# EasyEDA Pro project YanQi_Project_V2.0.eprj, board PayloadBoard (continued)
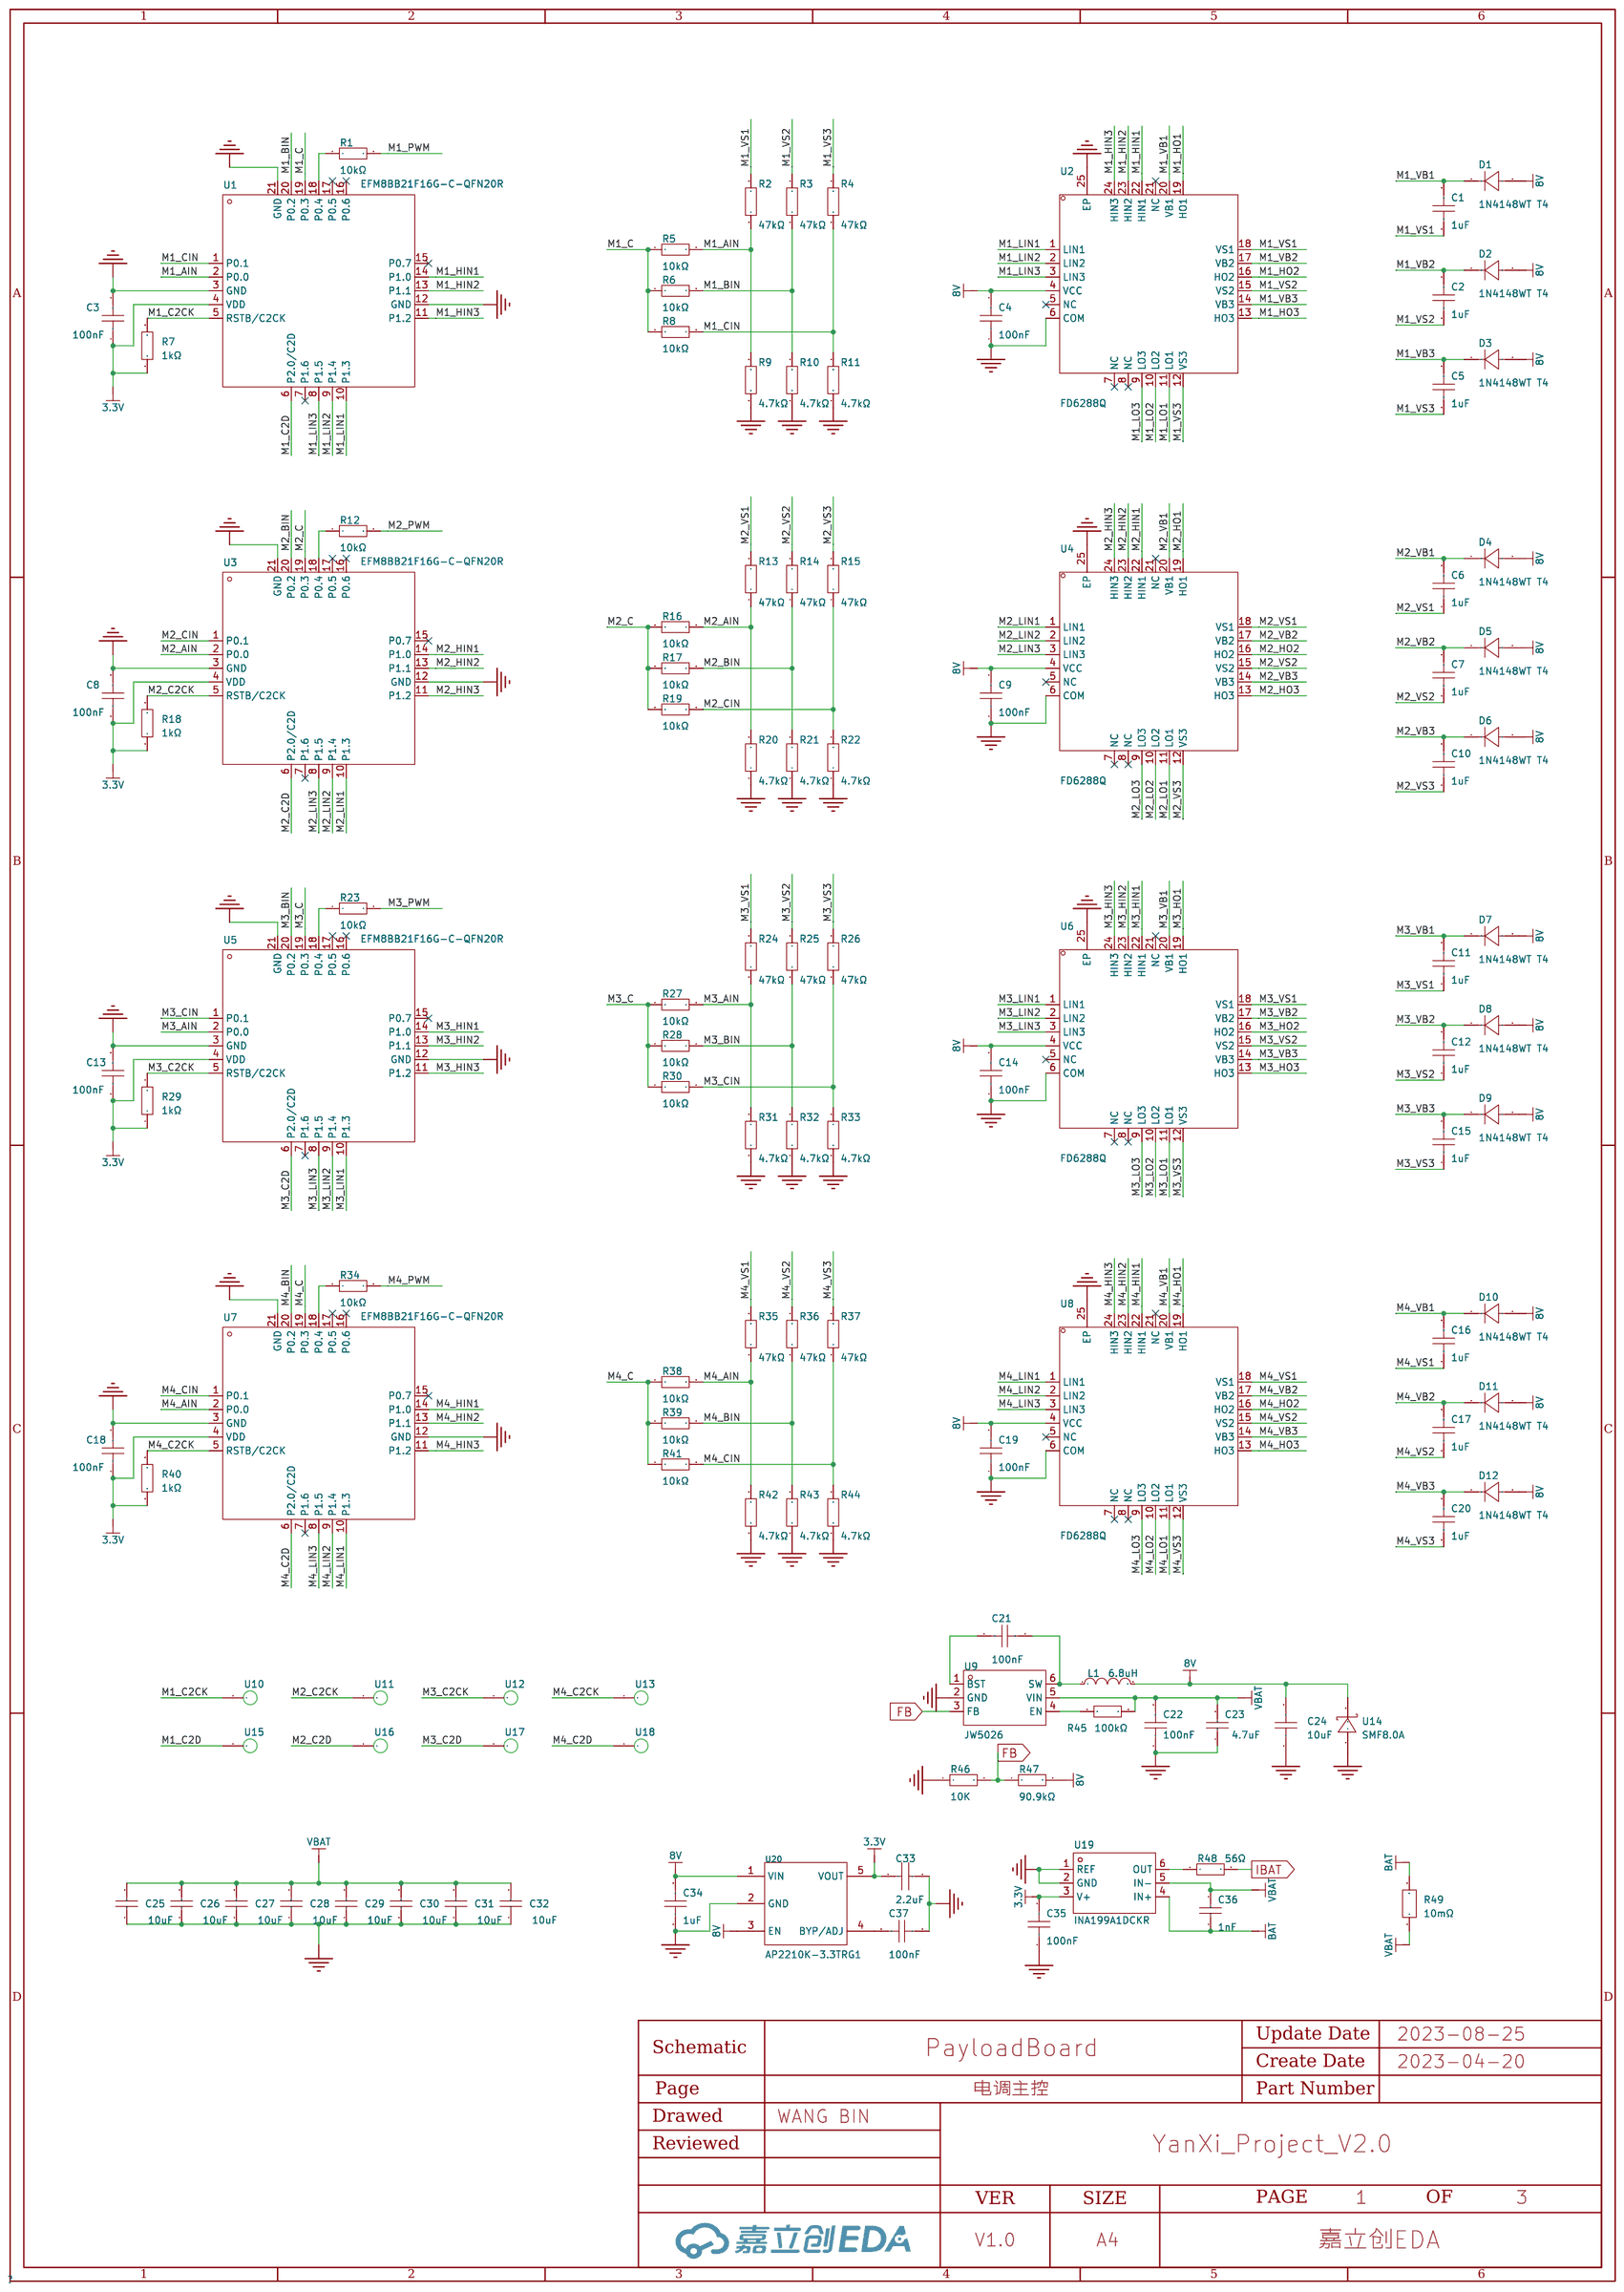
[diagram p0: 电调主控]
## Routing (per net, layer and track width the routed paths; a pad name or vN(x,y) marks a point on that pad's centre or on a via; arc(x,y) is an arc through that point) (continued)
$1N15748: length 2.1
  Top Layer w0.254: C21.2 63.21,83.16 U9.1
$1N20032: length 3.5
  Top Layer w0.254: 64.3,83.2 64.44,83.05 U9.6
  Top Layer w0.6: U9.6 65.64,81.7 L1.1
$1N20137: length 2.9
  Top Layer w0.254: v1(64.45,78.95) 64.44,78.95 U9.4
  Bottom Layer w0.254: v1(64.45,78.95) 63.28,78.95 62.63,79.6
$1N21202: length 3.5
  Top Layer w0.254: R48.1 22.25,80.48 22.25,82.67 22.58,83 U19.6
$1N30363: length 1.4
  Bottom Layer w0.254: U20.4 66,79.6 C37.2
$2N14203: length 12.4
  Inner1 w0.254: v1(71.75,72.7) 71.91,72.86 71.91,80.19 v1(71.8,80.3)
  Bottom Layer w0.254: LED1.3 72.18,80.67 v1(71.8,80.3) ; v1(71.75,72.7) 71.75,71.76 72.75,70.76 LED2.1
$2N14210: length 10
  Bottom Layer w0.254: LED3.1 72.72,60.25 72.06,60.25 71.8,60.51 71.8,68.4 71.97,68.58 LED2.3
$2N14292: length 10
  Bottom Layer w0.254: LED4.1 72.72,50.25 72.06,50.25 71.8,50.51 71.8,58.4 71.97,58.58 LED3.3
$2N14324: length 14.1
  Bottom Layer w0.254: v1(73.03,36) 73.19,36.17 73.19,41.21 71.75,42.66 71.75,48.4 71.93,48.58 LED4.3
$2N14717: length 16.8
  Inner1 w0.254: v1(15.6,71.2) 15.6,80.3 v1(15.7,80.4)
  Bottom Layer w0.254: v1(15.7,80.4) 15.7,80.6 16.17,81.08 LED6.3 ; v1(15.6,71.2) 14.3,71.2 13.8,70.7 13.8,68.05 14.12,67.72 LED7.1
$2N14723: length 17
  Bottom Layer w0.254: LED7.3 15.43,69.42 15.8,69.06 15.8,65.6 16.3,65.1 17.7,65.1 18.75,64.05 18.75,60.4 16.08,57.72 LED8.1
$2N14733: length 13.4
  Bottom Layer w0.254: LED9.1 13.97,47.72 13.8,47.9 13.8,59.25 13.95,59.4 14.72,59.4 LED8.3
$2N14739: length 17.5
  Bottom Layer w0.254: LED9.3 15.47,49.42 15.75,49.15 15.75,47.2 15.15,46.6 15.15,42.78 14.05,41.69 14.05,37.3 14.35,37 16.55,37 17.03,36.53 v1(17.03,36)

## Copper pours and planes (outline as drawn; the poured copper is in the pictures)
GND on Top Layer: -6.25,100 93.75,100 93.75,0 -6.25,0
GND on Bottom Layer: -6.25,100 93.75,100 93.75,0 -6.25,0
GND on Inner1: -6.25,100 93.75,100 93.75,0 -6.25,0
GND on Inner2: -6.25,100 93.75,100 93.75,0 -6.25,0
VBAT on Top Layer: 24.95,83.51 28.25,83.51 28.25,78.6 24.95,78.6
VBAT on Bottom Layer: 13,74.62 13,78.39 24.03,78.55 25,79.52 25,82.94 25,82.94 28.3,82.94 28.3,74.62
VBAT on Bottom Layer: 72.75,75.1 84.99,75.1 84.99,71.65 72.75,71.65
VBAT on Bottom Layer: 72.77,46.28 86.76,46.28 86.76,42.83 72.77,42.83
VBAT on Bottom Layer: 24.95,77.4 58.96,77.4 60.52,78.96 70.7,78.96 74.56,75.1 74.56,71.65 59.95,71.65 57.55,69.25 24.95,69.25
VBAT on Bottom Layer: 14.75,42.9 2.51,42.9 2.51,46.35 14.75,46.35
VBAT on Bottom Layer: 14.75,71.73 0.76,71.73 0.76,75.17 14.75,75.17
VBAT on Inner1: 72.75,75.1 74.55,75.1 74.55,42.83 72.75,42.83
VBAT on Inner1: 14.75,42.9 12.95,42.9 12.95,75.17 14.75,75.17
VBAT on Inner2: 24.95,77.4 58.96,77.4 60.52,78.96 70.7,78.96 74.56,75.1 74.56,71.65 59.95,71.65 57.55,69.25 24.95,69.25
VBAT on Inner2: 72.75,75.1 74.55,75.1 74.55,42.83 72.75,42.83
VBAT on Inner2: 72.77,46.28 86.76,46.28 86.76,42.83 72.77,42.83
VBAT on Inner2: 13,74.62 13,78.39 24.03,78.55 25,79.52 25,82.94 25,82.94 28.3,82.94 28.3,74.62
VBAT on Inner2: 72.75,75.1 84.99,75.1 84.99,71.65 72.75,71.65
VBAT on Inner2: 14.75,42.9 12.95,42.9 12.95,75.17 14.75,75.17
VBAT on Inner2: 14.73,71.73 0.74,71.73 0.74,75.17 14.73,75.17
VBAT on Inner2: 14.75,42.9 2.51,42.9 2.51,46.35 14.75,46.35
BAT on Top Layer: 24.95,77.4 42.7,77.4 42.7,70.65 24.95,70.65
M3_VS2 on Bottom Layer: 7.67,72.7 7.67,75.34 5.7,77.3 4.35,77.3 4.35,76.12 5.49,76.12 6.65,74.96 6.65,72.7
M4_VS2 on Bottom Layer: 79.84,45.3 79.84,42.67 81.8,40.7 83.15,40.7 83.15,41.89 82.01,41.89 80.85,43.04 80.85,45.3

## Text on the board
Bottom Silkscreen Layer: PROJECT | 雁栖
Top Silkscreen Layer: PROJECT | 雁栖
